# EAGLE board BMS-HVver3 (EAGLE 6.6.0), part 1 of 2 (continued)
## Placement (x,y rotation side) (continued)
SJ14  [PAD-JUMPER-3-NO_YES_SILK]  45.06,76.7 0 top
SJ15  [PAD-JUMPER-2-NO_YES_SILK]  44.91,71.75 90 top
TX1  PE-68386NLT  [PE-68386NLT]  145.92,80.16 0 top
TX2  PE-68386NLT  [PE-68386NLT]  145.92,70.38 0 top
TX3  PE-68386NLT  [PE-68386NLT]  145.92,91.46 0 top
U1  LTC6804-2  [SSOP-48]  127.61,71.27 270 top
U2  LTC6804-2  [SSOP-48]  82.04,71.14 270 top
U3  LTC6804-2  [SSOP-48]  37.08,71.27 270 top
U$1  POGOPIN  [POGOPIN]  125.65,11.12 0 top
U$2  POGOPIN  [POGOPIN]  116.08,18.64 0 top
U$3  POGOPIN  [POGOPIN]  126.9,27.37 0 top
U$4  POGOPIN  [POGOPIN]  116.08,36.14 0 top
U$5  POGOPIN  [POGOPIN]  126.92,44.9 0 top
U$6  POGOPIN  [POGOPIN]  116.08,53.64 0 top
U$7  POGOPIN  [POGOPIN]  126.92,62.38 0 top
U$8  POGOPIN  [POGOPIN]  116.08,71.14 0 top
U$9  POGOPIN  [POGOPIN]  126.92,79.88 0 top
U$10  POGOPIN  [POGOPIN]  116.05,88.61 0 top
U$11  POGOPIN  [POGOPIN]  126.92,97.38 0 top
U$12  POGOPIN  [POGOPIN]  116.08,106.11 0 top
U$13  POGOPIN  [POGOPIN]  125.68,113.63 0 top
U$14  POGOPIN  [POGOPIN]  34.87,11.12 0 top
U$15  POGOPIN  [POGOPIN]  25.27,18.61 0 top
U$16  POGOPIN  [POGOPIN]  36.12,27.37 0 top
U$17  POGOPIN  [POGOPIN]  25.27,36.14 0 top
U$18  POGOPIN  [POGOPIN]  36.12,44.87 0 top
U$19  POGOPIN  [POGOPIN]  25.27,53.64 0 top
U$20  POGOPIN  [POGOPIN]  36.12,62.38 0 top
U$21  POGOPIN  [POGOPIN]  25.27,71.14 0 top
U$22  POGOPIN  [POGOPIN]  36.12,79.88 0 top
U$23  POGOPIN  [POGOPIN]  25.27,88.61 0 top
U$24  POGOPIN  [POGOPIN]  36.12,97.38 0 top
U$25  POGOPIN  [POGOPIN]  25.27,106.11 0 top
U$26  POGOPIN  [POGOPIN]  34.87,113.63 0 top
U$27  LOGO16-2-L  [2016-2-LOGO-L]  49.5,15.08 90 top
U$28  NSV1C201MZ4T1G  [SOT223]  41.05,90.65 0 top
U$29  NSV1C201MZ4T1G  [SOT223]  88.01,89.68 0 top
U$30  NSV1C201MZ4T1G  [SOT223]  134.62,89.68 0 top
U$40  POGOPIN  [POGOPIN]  80.26,11.12 0 top
U$41  POGOPIN  [POGOPIN]  70.66,18.61 0 top
U$42  POGOPIN  [POGOPIN]  81.51,27.35 0 top
U$43  POGOPIN  [POGOPIN]  70.66,36.11 0 top
U$44  POGOPIN  [POGOPIN]  81.51,44.85 0 top
U$45  POGOPIN  [POGOPIN]  70.66,53.64 0 top
U$46  POGOPIN  [POGOPIN]  81.51,62.38 0 top
U$47  POGOPIN  [POGOPIN]  70.66,71.11 0 top
U$48  POGOPIN  [POGOPIN]  81.51,79.88 0 top
U$49  POGOPIN  [POGOPIN]  70.66,88.64 0 top
U$50  POGOPIN  [POGOPIN]  81.51,97.38 0 top
U$51  POGOPIN  [POGOPIN]  70.66,106.11 0 top
U$52  POGOPIN  [POGOPIN]  80.26,113.61 0 top

## Tracks (layer width: path | path; a pad name or v marks a point on that pad's centre or on a via)
A0
  Top 0.178: U2.45 90.36,75.39 90.68,75.71 90.68,76.78 SJ9.2
A1
  Top 0.178: U2.46 87.55,75.89 87.76,76.09 87.76,77.87 88.01,78.12 90.55,78.12 90.68,78.25 90.68,79.32 SJ8.2
A2
  Top 0.178: U2.47 87.04,76.39 87.25,76.6 87.25,80.16 87.76,80.66 90.42,80.66 90.75,80.99 SJ7.2
A3
  Top 0.178: U2.48 86.52,76.89 86.74,77.11 86.74,82.95 87.25,83.46 90.42,83.46 90.68,83.71 90.68,84.58 SJ6.2
A4
  Top 0.178: U1.45 133.64,75.52 134.21,76.09 134.21,78.5 134.65,78.94 136.6,78.94 136.78,78.76 136.78,77.74 SJ4.2
A5
  Top 0.178: U1.46 133.43,76.02 133.73,76.32 133.73,81.07 134.21,81.55 136.53,81.55 136.73,81.35 136.73,80.28 SJ3.2
A6
  Top 0.178: U1.47 133.11,76.52 133.3,76.7 133.3,83.38 133.91,83.99 136.45,83.99 136.75,83.69 SJ2.2
A7
  Top 0.178: U1.48 132.55,77.02 132.79,77.26 132.79,85.01 134.42,86.63 136.5,86.63 136.73,86.4 136.73,85.36 SJ1.2
A8
  Top 0.178: U3.45 42.35,75.52 42.62,75.79 42.62,77.69 42.95,78.02 44.96,78.02 45.06,77.92 SJ14.2
A9
  Top 0.178: U3.46 41.86,76.02 42.14,76.29 42.14,80.16 42.7,80.71 44.86,80.71 45.06,80.51 SJ13.2
A10
  Top 0.178: U3.47 41.39,76.52 41.63,76.75 41.63,83.08 42.11,83.56 44.83,83.56 45.06,83.33 SJ12.2
A11
  Top 0.178: U3.48 41.01,77.02 41.05,77.06 41.05,85.79 41.66,86.4 44.81,86.4 45.03,86.17 45.03,84.88 SJ11.2
C0  (via drill 0.3)
  Top 0.178: U2.26 86.4,65.89 86.61,65.68 86.61,64.41 86.36,64.15 78.74,64.15 78.36,63.77 78.36,16.1 | 78.36,16.1 78.36,16.02 78.99,15.38 80.43,15.38 | 80.43,15.38 R110.2 | 80.43,15.38 80.43,16.91 C57.1 | v77.57,15.72 77.57,15.87 77.8,16.1 78.36,16.1
  Bottom 0.178: C55.2 77.94,16.08 v77.57,15.72
C1  (via drill 0.3)
  Top 0.178: U2.24 77.94,65.39 77.6,65.04 77.6,21.1 | 77.6,21.1 77.6,19.07 74.68,16.15 R107.2 | v75.95,21.1 77.6,21.1
  Bottom 0.178: C53.2 75.69,21.35 v75.95,21.1 76.24,20.81 C55.1
C2  (via drill 0.3)
  Top 0.178: U2.22 77.17,66.39 76.71,65.93 76.71,29.99 | 76.71,29.99 76.71,29.74 74.8,27.83 73.53,27.83 | 73.53,27.83 69.48,27.83 R104.2 | v75.69,29.99 76.71,29.99 | v73.53,26.18 73.53,27.83
  Bottom 0.178: C51.2 75.31,30.37 v75.69,29.99 | C53.1 75.69,25.93 75.44,26.18 v73.53,26.18
C3  (via drill 0.3)
  Top 0.178: U2.20 76.26,67.39 75.95,67.07 75.95,38.25 | 75.95,38.25 75.95,34.94 75.5,34.5 | 75.5,34.5 74.8,33.8 R101.2 | v74.93,38.25 75.95,38.25 | v74.93,35.07 75.5,34.5
  Bottom 0.178: C49.2 74.17,38.37 74.3,38.25 v74.93,38.25 | C51.1 75.31,34.69 v74.93,35.07
C4  (via drill 0.3)
  Top 0.178: U2.18 75.61,68.39 75.18,67.96 75.18,47.77 | 75.18,47.77 75.18,46.75 73.15,44.72 | 73.15,44.72 R98.2 | v74.17,47.77 75.18,47.77 | v73.28,43.71 73.28,44.59 73.15,44.72
  Bottom 0.178: C47.2 73.79,48.15 v74.17,47.77 | C49.1 74.17,43.45 73.91,43.71 v73.28,43.71
C5  (via drill 0.3)
  Top 0.178: U2.16 74.83,69.39 74.42,68.98 74.42,59.07 | 74.42,59.07 74.42,52.6 73.79,51.96 | R92.2 69.33,51.45 73.28,51.45 73.79,51.96 | v73.15,59.2 74.3,59.2 74.42,59.07 | 73.79,51.96 73.79,52.34 v73.41,52.72
  Bottom 0.178: C43.2 72.39,59.58 72.77,59.2 v73.15,59.2 | v73.41,52.72 73.41,52.6 73.91,52.09 73.91,51.29 C47.1
C6  (via drill 0.3)
  Top 0.178: U2.14 74.05,70.39 73.66,70 73.66,66.44 | 73.66,66.44 73.66,63.65 73.15,63.14 72.26,63.14 | 69.18,63.65 R95.2 69.43,63.14 72.26,63.14 | v72.14,63.65 72.14,63.26 72.26,63.14 | 73.66,66.44 73.53,66.31 v73.03,66.31
  Bottom 0.178: C43.1 72.39,63.39 v72.14,63.65 | v73.03,66.31 72.64,66.31 72.39,66.57 72.39,67.7 C45.2
C7  (via drill 0.3)
  Top 0.178: U2.12 73.28,71.39 73.15,71.27 | 73.15,71.27 72.9,71.01 72.9,69.87 71.88,68.98 69.18,68.98 R89.2 | v71.88,74.57 71.88,72.53 73.15,71.27
  Bottom 0.178: C41.2 v71.88,74.57 72.64,73.81 C45.1
C8  (via drill 0.3)
  Top 0.178: U2.10 73.68,72.39 73.41,72.66 73.41,78.89 73.34,78.95 | 73.34,78.95 72.01,80.28 | 72.01,80.28 69.61,80.28 R86.2 | v72.26,81.68 72.26,80.66 72.01,80.41 72.01,80.28 | v71.88,78.89 73.28,78.89 73.34,78.95
  Bottom 0.178: C39.2 v72.26,81.68 | C41.1 71.88,77.36 72.01,77.23 72.01,78.76 v71.88,78.89
C9  (via drill 0.3)
  Top 0.178: U2.8 74.59,73.39 74.3,73.68 74.3,84.98 73.28,86 73.15,86 | 73.15,86 72.39,86 | 72.39,86 R83.2 | v73.66,91.33 73.66,86.5 73.15,86 | v72.39,87.14 72.39,86
  Bottom 0.178: C37.2 73.53,91.46 v73.66,91.33 | C39.1 72.26,87.01 v72.39,87.14
C10  (via drill 0.3)
  Top 0.178: U2.6 75.24,74.39 75.06,74.57 75.06,96.28 73.91,97.43 73.79,97.43 | 73.79,97.43 73.66,97.43 | 73.66,97.43 69.56,97.43 R77.2 | v73.66,96.28 73.66,97.43 | v73.91,99.84 73.91,97.55 73.79,97.43
  Bottom 0.178: C37.1 73.53,96.16 v73.66,96.28
  Bottom 0.254: C34.2 v73.91,99.84
C11  (via drill 0.3)
  Top 0.178: U2.4 76.14,75.39 75.82,75.71 75.82,102.25 73.91,104.16 | 73.91,104.16 69.56,104.16 R78.2 | v74.04,105.43 74.04,104.28 73.91,104.16
  Bottom 0.178: C34.1 73.91,105.3 v74.04,105.43 74.17,105.56 74.17,107.46 74.3,107.59 C33.2
C12  (via drill 0.3)
  Top 0.178: U2.2 76.79,76.39 76.58,76.6 76.58,105.43 79.12,107.97 79.12,108.35 | 79.12,108.35 79.12,111.14 78.87,111.4 R76.2 | v79.25,108.22 79.12,108.35
  Bottom 0.178: C33.1 78.61,107.59 v79.25,108.22
C13  (via drill 0.3)
  Top 0.178: R4.2 124.66,110.97 125.55,110.08 125.55,107.26 | 125.55,107.26 125.55,106.34 123.7,104.49 123.7,78.28 123.04,77.61 123.04,76.65 123.17,76.52 U1.2 | v124.51,107.21 125.5,107.21 125.55,107.26
  Bottom 0.178: C3.1 124.28,106.11 124.51,106.34 v124.51,107.21
C14  (via drill 0.3)
  Top 0.178: R6.2 121.54,100.68 | 121.54,100.68 122.3,100.68 122.94,100.04 122.94,78.66 122.28,78 122.28,76.07 122.81,75.53 124.17,75.53 U1.4 | v121.51,103.24 121.51,100.7 121.54,100.68
  Bottom 0.178: C4.1 121.54,103.22 v121.51,103.24 121.53,103.26 C3.2
C15  (via drill 0.3)
  Top 0.178: R11.2 119.18,86.12 | 119.18,86.12 120.5,86.12 121.39,85.23 121.39,79.32 120.68,78.61 120.68,75.41 122.58,73.5 124.17,73.5 U1.8 | v119.13,86.99 119.13,86.17 119.18,86.12
  Bottom 0.178: C9.1 119.02,86.89 v119.13,86.99 119.1,87.01 C7.2
C16  (via drill 0.3)
  Top 0.178: U1.12 119.43,71.52 118.91,71 | 118.91,71 116.74,68.83 115.56,68.83 R17.2 | v118.8,71.82 118.8,71.11 118.91,71
  Bottom 0.178: C15.1 118.82,71.8 v118.8,71.82 118.75,71.88 C11.2
C17  (via drill 0.3)
  Top 0.178: U1.14 120.13,70.52 117.07,67.45 117.07,65.17 | 117.07,65.17 117.07,62.68 116.74,62.35 115.81,62.35 R23.2 | v116.21,65.14 117.04,65.14 117.07,65.17
  Top 0.254: v116.76,61.31 115.95,61.31 115.85,61.41 115.85,62.31 R23.2
  Bottom 0.178: C15.2 118.82,66.06 118.34,65.58 116.64,65.58 v116.21,65.14
  Bottom 0.254: C13.1 116.38,60.93 v116.76,61.31
C18  (via drill 0.3)
  Top 0.178: U1.16 120.5,69.52 118.03,67.05 118.03,56.05 118.03,52.06 117.72,51.74 117.32,51.35 115.21,51.35 115.11,51.45 115.11,51.25 115.14,51.22 115.12,51.22 R20.2
  Top 0.254: v116.71,56.08 118.01,56.08 118.03,56.05 | v117.35,52.24 117.35,52.11 117.72,51.74
  Bottom 0.254: C13.2 116.38,56.41 v116.71,56.08 | C17.1 117.7,51.88 v117.35,52.24
C19  (via drill 0.3)
  Top 0.178: U1.20 121.29,67.52 119.94,66.16 119.94,37.66 119.94,35.83 119.3,35.2 | v119.24,35.13 118.03,33.93 R29.2
  Top 0.254: v119.05,37.59 119.86,37.59 119.94,37.66 | v119.24,35.13 119.3,35.2
  Bottom 0.254: C19.2 118.92,37.71 v119.05,37.59 | C23.1 119.53,34.84 v119.24,35.13
C20  (via drill 0.3)
  Top 0.178: U1.22 121.69,66.52 120.9,65.73 120.9,30.35 120.42,29.86 | v120.16,29.6 117.88,27.32 117.75,27.32 R32.2
  Top 0.254: v120.16,29.6 120.42,29.86 | v118.8,26.31 118.77,26.31 117.75,27.32
  Bottom 0.254: C23.2 119.53,30.22 v120.16,29.6 | C25.1 120.34,25.77 120.04,26.08 119.02,26.08 v118.8,26.31
C21  (via drill 0.3)
  Top 0.178: U1.24 122.16,65.52 121.9,65.25 121.9,20.57 121.9,17.14 121.27,16.52 | v121.32,16.62 118.72,13.96 116.32,13.96 R35.2
  Top 0.254: v120.17,20.62 121.84,20.62 121.9,20.57 | v121.32,16.62 121.27,16.52
  Bottom 0.254: C25.2 120.34,20.8 v120.17,20.62 | C27.1 121.58,16.31 v121.32,16.62
C22  (via drill 0.3)
  Top 0.178: R5.2 v121.34,95.52 121.62,95.52 122.17,94.96 122.17,78.99 121.49,78.3 121.49,75.69 122.66,74.52 U1.6
  Top 0.254: v121.28,98.44 121.28,95.57 v121.34,95.52
  Bottom 0.178: C7.1 119.1,95.14 119.48,95.52 v121.34,95.52
  Bottom 0.254: C4.2 121.54,98.7 v121.28,98.44
C23  (via drill 0.3)
  Top 0.178: R38.2 123.41,14.89 122.83,15.46 122.83,63.72 123.34,64.23 131.72,64.23 132.33,64.84 132.33,65.88 132.21,66.01 U1.26
  Top 0.254: v124.71,16.17 125.15,16.17 125.55,15.77 125.55,14.94 R38.2
  Bottom 0.254: C29.1 123.28,18 C27.2 124.48,15.38 124.71,15.61 v124.71,16.17
C24  (via drill 0.3)
  Top 0.178: U1.18 120.87,68.52 118.97,66.62 118.97,46.58 118.64,46.25 117.3,44.9 116.79,44.9 115.2,44.9 R26.2
  Top 0.254: v118.03,46.93 118.03,46.86 118.64,46.25 | v116.81,43.76 116.81,44.87 116.79,44.9
  Bottom 0.254: C17.2 117.7,47.26 v118.03,46.93 | C19.1 118.92,43.22 118.59,43.55 117.02,43.55 v116.81,43.76
C25  (via drill 0.3)
  Top 0.178: R14.2 118.44,78.89 | 118.44,78.89 119.05,78.89 | 119.05,78.89 119.89,78.05 119.89,75.1 122.48,72.51 U1.10 | v118.42,77.87 118.42,78.86 118.44,78.89 | v119,81.27 119,78.94 119.05,78.89
  Bottom 0.178: C11.1 118.75,77.54 v118.42,77.87 | C9.2 119.02,81.5 v119,81.27
C26  (via drill 0.3)
  Top 0.178: U3.2 31.66,76.52 31.3,76.87 31.3,101.4 31.93,102.02 32.82,102.02 33.53,102.74 33.53,102.91 | 33.53,102.91 33.53,105.06 R151.2 | v33.88,102.56 33.53,102.91
  Bottom 0.178: C65.1 33.73,102.71 v33.88,102.56
C27  (via drill 0.3)
  Top 0.178: U3.4 30.7,75.52 30.42,75.89 30.42,100.69 v29.97,101.13 29.71,101.4 29.62,101.49 23.79,101.49 R153.2
  Bottom 0.178: C65.2 29.77,102.71 29.62,102.56 29.62,101.49 v29.97,101.13 29.79,100.96 29.79,99.89 29.59,99.69 C66.1
C28  (via drill 0.3)
  Top 0.178: U3.8 28.88,73.52 28.64,73.75 28.64,85.93 28.19,86.38 27.48,86.38 | 27.48,86.38 24.32,86.38 R158.2 | v27.66,87.62 27.66,86.56 27.48,86.38
  Bottom 0.178: C71.1 27.51,87.47 v27.66,87.62 27.69,87.65 C69.2
C29  (via drill 0.3)
  Top 0.178: U3.12 27.82,71.52 27.57,71.27 27.57,69.84 | 27.57,69.84 27.57,69.49 26.89,68.8 R164.2 | v26.77,69.84 27.57,69.84
  Bottom 0.178: C77.1 26.62,69.69 v26.77,69.84 27.51,70.58 C73.2
C30  (via drill 0.3)
  Top 0.178: U3.14 28.78,70.52 28.46,70.2 28.46,65.75 27.22,64.51 26.77,64.51 | R170.2 26.77,64.51 | v26.77,65.4 26.77,64.51 | v26.65,62.22 26.65,64.38 26.77,64.51
  Bottom 0.178: C77.2 26.62,65.55 v26.77,65.4 | C75.1 v26.65,62.22
C31  (via drill 0.3)
  Top 0.178: U3.16 29.73,69.52 29.35,69.13 29.35,57.75 29.26,57.66 | R167.2 28.35,51.5 29.26,52.42 29.26,53.31 | 29.26,53.31 29.26,57.66 | v28.19,53.31 29.26,53.31 | v26.92,57.83 29.1,57.83 29.26,57.66
  Bottom 0.178: C79.1 28.4,53.1 v28.19,53.31 | C75.2 26.65,58.11 v26.92,57.83
C32  (via drill 0.3)
  Top 0.178: U3.20 31.2,67.52 31.04,67.35 31.04,36.06 30.68,35.7 | R176.2 28.88,33.9 30.68,35.7 | v29.97,36.24 30.15,36.24 30.68,35.7
  Bottom 0.178: C83.1 30.25,35.96 v29.97,36.24 29.46,36.75 C81.2
C33  (via drill 0.3)
  Top 0.178: U3.22 31.98,66.52 31.75,66.29 31.75,30.9 | 31.75,30.9 31.75,29.66 29.52,27.42 v25.53,27.42 23.93,27.42 R179.2 | v30.51,31.08 31.57,31.08 31.75,30.9
  Bottom 0.178: C83.2 30.25,31.34 v30.51,31.08 | C85.1 25.85,27.11 v25.53,27.42
C34  (via drill 0.3)
  Top 0.178: U3.24 32.76,65.52 32.46,65.22 32.46,28.06 29.08,24.68 29.08,23.97 | R182.2 27.48,14.19 29.08,15.79 29.08,17.57 | 29.08,17.57 29.08,23.97 | v27.84,23.97 29.08,23.97 | v28.19,17.39 28.91,17.39 29.08,17.57
  Bottom 0.178: C85.2 27.55,24.26 v27.84,23.97 | C87.1 28.22,17.42 v28.19,17.39
C35  (via drill 0.3)
  Top 0.178: U3.6 29.83,74.52 29.53,74.82 29.53,95.18 29.08,95.62 v27.48,95.62 26.59,95.62 26.24,95.98 26.24,97.06 R152.2
  Top 0.254: R152.2 26.1,97.97 25.88,98.19 24.84,98.19 v24.61,98.42
  Bottom 0.178: C69.1 27.69,95.42 v27.48,95.62
  Bottom 0.254: v24.61,98.42 24.61,99.41 24.94,99.74 27.01,99.74 C66.2
C36  (via drill 0.5)
  Top 0.178: U3.26 40.56,66.01 41.5,66.01 41.71,65.77 41.71,65.22 41.53,65.04 38.86,65.04 38.33,64.51 33.35,64.51 33.17,64.33 33.17,17.39 v33.35,17.21 34.77,17.21 34.98,17.01 R185.2
  Bottom 0.178: C87.2 33.15,17.42 v33.35,17.21 33.41,17.15 C89.1
C37  (via drill 0.3)
  Top 0.178: U3.18 30.51,68.52 30.24,68.24 30.24,51.35 30.15,51.26 30.15,48.51 | R173.2 29.26,44.52 | 29.26,44.52 29.9,44.52 30.15,44.77 30.15,48.51 | v28.73,48.51 30.15,48.51 | v29.26,43.53 29.26,44.52
  Bottom 0.178: C79.2 28.4,48.84 v28.73,48.51 | C81.1 29.46,43.33 v29.26,43.53
C38  (via drill 0.3)
  Top 0.178: U3.10 28.01,72.52 27.83,72.7 27.83,78.56 | 27.83,78.56 27.83,79.28 27.3,79.8 | 27.3,79.8 23.99,79.8 R161.2 | v26.95,78.56 27.83,78.56 | v27.3,81.58 27.3,79.8
  Bottom 0.178: C73.1 27.51,78 v26.95,78.56 | C71.2 27.51,81.78 v27.3,81.58
DRIVE  (via drill 0.3)
  Top 0.178: U$29.P$1 86.87,89.68 86.49,89.3 86.49,84.65 v86.56,84.58 | v87,72.05 86.84,71.9 85.48,71.9 U2.38
  Bottom 0.178: v86.56,84.58 86.56,72.48 v87,72.05
DRIVE1  (via drill 0.3)
  Top 0.178: U$30.P$1 134.62,88.08 v132,85.46 | v132.51,72.31 132.16,72 131.04,72 U1.38
  Bottom 0.178: v132,85.46 132,72.81 v132.51,72.31
DRIVE2  (via drill 0.3, 0.5)
  Top 0.178: U3.38 41.85,72.02 v42.06,72.23 | v40.95,87.24 41,90.59 U$28.P$1
  Bottom 0.178: v40.95,87.24 40.97,85.62 41.02,74.44 42.06,73.22 v42.06,72.23
GND  (via drill 0.3, 0.5, 0.6)
  Top 0.178: v38.86,67.07 39.04,68.24 39.4,68.6 40.42,68.6 U3.31
  other vias: 41.94,45.5 22.5,107.89 28.19,116.43 9.88,100.25 15.04,90.65 9.88,92.78 4.72,94.38 13.61,83.18 13.97,74.47 10.06,77.67 4.19,78.73 4.01,86.56 4.01,101.31 25.17,111.98 37.08,101.31 11.84,39.26 4.01,41.22 4.19,49.22 4.19,56.33 4.19,63.62 4.01,71.09 11.13,69.84 14.5,59 10.24,62.91 27.3,46.91 14.5,54.02 14.5,45.48 13.61,31.08 24.46,39.79 5.79,33.75 4.19,26.28 14.68,21.13 47.32,74.97 46.53,69.49 48.11,52.29
  pour Top (rank 4): -2.54,130.95 49.53,130.95 49.53,-6.2 -2.54,-6.2
  pour Bottom: -2.54,129.69 49.53,129.69 49.53,-7.47 -2.54,-7.47
GNDA  (via drill 0.5)
  other vias: 90.02,61.89 80.29,35.53 83.31,41.75 74.24,18.99 93.32,78.28 78,81.3 94.62,73.84 65.99,6.93 77.67,14.17 75.64,9.21 76.4,7.94 62.31,12.9 62.56,17.59 56.08,18.99 56.85,27.5 72.47,30.04 73.36,37.28 54.56,41.22 54.94,34.87 72.47,47.31 62.56,38.68 54.69,49.85 61.16,53.79 67.77,59 55.07,57.6 55.19,65.22 65.86,74.62 63.45,70.3 54.69,70.81 54.94,79.7 63.58,82.49 60.78,75.89 56.59,86.17 72.47,91.76 61.54,91.25 56.72,93.92 71.58,99.89 56.59,102.68
  pour Top (rank 6): 52.07,130.95 52.07,-6.2 95.25,-6.2 95.25,130.95
  pour Bottom (rank 6): 52.07,129.69 52.07,-7.47 95.25,-7.47 95.25,129.69
GNDI  (via drill 0.5)
  Top 0.178: U1.31 U1.30
  other vias: 140.89,76.09 127.05,86.66 115.98,91.41 109.37,81.88 110.24,74.54 109.07,69.72 110.92,64.81 111.71,57.8 108.84,53.54 113.84,47.06 114.33,40.28 108.76,38.12 115.09,29.66 115.54,22.45 103.07,19.27 127.74,111.09 99.14,111.52 102.29,106.72 119.43,104.44 121.46,122.27 100.23,122.04
  pour Top (rank 4): 97.79,129.69 97.79,-3.67 137.16,-3.67 137.16,26.81 142.24,31.89 142.24,57.3 140.97,58.56 140.97,130.19
  pour Bottom: 97.79,-2.39 97.79,128.42 140.97,129.05 140.97,58.56 142.24,57.3 142.24,31.89 137.16,26.81 137.16,-3.67
GPIO1
  Top 0.178: U2.27 86.67,66.39 87.12,65.93 87.12,54.25 | R139.4 87.61,53.76 87.12,54.25 | NTC8.2 84.2,20.06 85.88,21.73 85.88,53.61 86.51,54.25 87.12,54.25
GPIO2  (via drill 0.3)
  Top 0.178: U2.28 86.8,66.89 87.5,66.19 87.5,55.26 88.16,54.61 v88.24,54.61 88.39,54.61 R139.3
  Bottom 0.178: NTC7.2 84.02,55.44 84.25,55.67 87.18,55.67 v88.24,54.61
GPIO3  (via drill 0.3)
  Top 0.178: R139.2 88.63,55.41 87.88,56.15 87.88,66.57 87.06,67.39 U2.29 84.15,67.38 v84.07,67.3
  Bottom 0.178: NTC6.2 85.16,107.45 85.7,106.9 85.7,67.62 U2.29 84.16,67.39 v84.07,67.3
GPIO4  (via drill 0.3)
  Top 0.178: R139.1 88.92,56.26 88.39,56.79 88.39,66.95 86.45,68.89 U2.32 v83.8,68.88
  Bottom 0.178: NTC5.2 84.95,89.92 85.27,89.6 85.27,69.26 84.91,68.9 83.82,68.9 v83.8,68.88
GPIO5  (via drill 0.3)
  Top 0.178: U2.33 86.59,69.39 88.9,67.07 88.9,59.58 89.34,59.14 | R138.2 93.38,65.04 93.47,65.04 93.6,65.17 94.49,65.17 94.87,64.79 94.87,59.96 94.36,59.45 93.47,59.45 93.09,59.07 89.41,59.07 89.34,59.14 | D38.C 85.84,57.28 v85.65,57.09 | v89.26,57.45 89.26,59.05 89.34,59.14
  Bottom 0.178: v85.65,57.09 88.9,57.09 v89.26,57.45
GPIO6  (via drill 0.3)
  Top 0.178: R67.2 135.99,50.23 135.13,50.23 134.47,50.89 134.47,67.23 134.18,67.52 U1.29 129.72,67.51 v129.51,67.3
  Bottom 0.178: NTC10.2 131.05,89.94 130.73,89.63 130.73,67.89 130.35,67.51 129.72,67.51 v129.51,67.3
GPIO7  (via drill 0.3)
  Top 0.178: R67.1 135.99,51.12 135.25,51.12 134.87,51.5 134.87,68.6 134.46,69.02 U1.32 129.6,69.02 v129.26,68.67
  Bottom 0.178: NTC9.2 133.42,107.47 133.78,107.1 133.78,103.88 131.06,101.16 131.06,101.13 130.76,100.83 130.76,91.33 130.35,90.92 130.35,69.74 129.29,68.67 v129.26,68.67
GPIO8  (via drill 0.3)
  Top 0.178: U1.27 133.45,66.52 133.68,66.29 133.68,49.37 134.37,48.68 134.42,48.63 | 134.42,48.63 134.47,48.58 135.99,48.58 R67.4 | v134.42,47.95 134.42,48.63
  Bottom 0.178: NTC12.2 133.59,19.48 134.37,20.26 134.37,47.9 v134.42,47.95
GPIO9  (via drill 0.3)
  Top 0.178: U1.28 133.84,67.02 134.09,66.77 134.09,50.11 134.58,49.61 v134.62,49.57 134.75,49.45 R67.3
  Bottom 0.178: NTC11.2 131.72,50.21 132.16,49.78 134.42,49.78 v134.62,49.57
GPIO10
  Top 0.178: U1.33 137.11,69.52 137.54,69.08 137.54,62.6 138.05,62.1 139.36,62.1 D39.C 139.45,62.01 R66.2
GPIO11  (via drill 0.3)
  Top 0.178: R214.2 41.93,49.19 41.96,49.22 38.08,49.22 37.64,49.65 37.64,59.63 39.75,61.74 44.2,61.74 45.03,62.58 45.03,66.46 43.98,67.52 41.91,67.52 | U3.29 41.91,67.52 | v41.89,67.84 41.89,67.54 41.91,67.52
  Bottom 0.178: NTC2.2 37.45,89.87 37.14,89.55 37.14,82.87 37.54,82.47 38.94,82.47 39.37,82.03 39.37,69.06 39.62,68.8 41.35,68.8 41.66,68.5 41.66,68.06 v41.89,67.84
GPIO12  (via drill 0.3)
  Top 0.178: R214.1 40.58,50.04 40.34,50.28 40.34,60.47 41.07,61.21 44.35,61.21 45.57,62.43 45.57,66.74 43.3,69.02 43.05,69.02 | U3.32 43.05,69.02 | v42.95,68.42 42.95,68.91 43.05,69.02
  Bottom 0.178: NTC1.2 38.81,92.58 40.16,91.23 40.16,69.82 40.56,69.41 42.43,69.41 42.82,69.02 42.82,68.55 v42.95,68.42
GPIO13  (via drill 0.3)
  Top 0.178: R214.4 v39.93,47.54 37.72,47.54 36.68,48.58 36.68,59.99 39.57,62.88 43.71,62.88 43.99,63.16 43.99,65.91 43.37,66.5 43.31,66.52 U3.27
  Bottom 0.178: NTC4.2 40.6,17.74 40.87,18 40.87,46.6 v39.93,47.54
GPIO14  (via drill 0.3)
  Top 0.178: R214.3 41.84,48.35 v38.18,48.35 37.92,48.35 37.24,49.04 37.24,59.91 39.57,62.25 44.02,62.25 44.5,62.73 44.5,66.34 43.82,67.02 U3.28
  Bottom 0.178: NTC3.2 37.48,54.46 37.24,54.22 37.24,49.29 v38.18,48.35
GPIO15  (via drill 0.3)
  Top 0.178: R213.2 44.55,60.55 45.26,61.26 | 45.26,61.26 46.15,62.15 46.15,67.45 44.07,69.54 40.53,69.54 U3.33 | v45.67,60.85 45.26,61.26
  Top 0.305: D37.C 48.62,58.18 v48.69,58.11
  Bottom 0.305: v48.69,58.11 46.2,58.11 45.8,58.51 45.8,60.72 v45.67,60.85
IBIAS  (via drill 0.3)
  Top 0.254: U2.44 84.01,74.89 v83.57,75.33
  Bottom 0.254: v83.57,75.33 82.42,75.33 82.17,75.58 82.17,75.47 R141.2
IBIAS1  (via drill 0.3)
  Top 0.254: U1.44 129.19,75.02 129.03,75.18 129.03,76.32 v128.98,76.37
  Bottom 0.254: v128.98,76.37 127.65,76.37 R69.2
IBIAS2  (via drill 0.3)
  Top 0.178: U3.44 38.92,75.02 v38.63,75.3
  Bottom 0.178: v38.63,75.3 37.33,75.3 R216.2
ICMP  (via drill 0.3)
  Top 0.254: U2.43 84.15,74.39 v83.57,73.81
  Bottom 0.254: v83.57,73.81 82.21,73.81 R141.1 82.17,73.67 82.17,73.55 82.12,73.5 R142.2
ICMP1  (via drill 0.3)
  Top 0.254: U1.43 129.28,74.52 v129.11,74.34
  Bottom 0.254: v129.11,74.34 127.98,74.34 127.67,74.65 | 127.67,74.65 R69.1 | R70.2 127.58,74.57 127.67,74.65
ICMP2  (via drill 0.3)
  Top 0.178: U3.43 39.12,74.52 v38.41,73.53
  Bottom 0.178: v38.41,73.53 37.31,73.53 | 37.31,73.53 37.25,73.53 R216.1 | R217.2 37.21,73.3 37.08,73.42 37.21,73.42 37.31,73.53
IMA  (via drill 0.3)
  Top 0.178: 94.62,75.84 94.62,107.64 v94.97,107.99 | v140.64,77.64 142.52,77.64 TX1.3
  Top 0.254: U2.41 87.09,73.39 87.88,74.19 92.96,74.19 94.62,75.84
  Bottom 0.178: v94.97,107.99 95,107.99 95.5,108.5 103.4,108.5 104.57,109.67 113.41,109.67 114.58,108.5 138.79,108.5 140.26,107.03 140.26,90.09 139.72,89.55 139.72,87.98 140.26,87.44 140.26,78.02 v140.64,77.64
IMA1
  Top 0.178: U1.41 132.43,73.52 133.53,74.62 140.79,74.62 140.97,74.44 140.97,72.92 141.5,72.38 141.5,68.17 141.83,67.84 TX2.3
IMA2  (via drill 0.3)
  Top 0.178: U3.41 48.58,73.52 49.63,74.57 49.63,110.61 51.51,112.49 v52.58,112.49 | v141.1,88.84 142.39,88.84 142.47,88.77 142.42,88.77 142.39,88.79 142.42,88.79 TX3.3
  Bottom 0.178: v52.58,112.49 76.89,112.49 80.01,109.37 102.87,109.37 104.01,110.51 113.77,110.51 114.86,109.42 140.59,109.37 141.55,108.4 141.55,89.3 v141.1,88.84
IPA  (via drill 0.3)
  Top 0.178: 94.11,75.96 94.08,108.37 v93.83,108.63 | v141.28,82.64 142.49,82.64 TX1.1
  Top 0.254: U2.42 86.82,73.89 87.63,74.69 92.84,74.69 94.11,75.96
  Bottom 0.178: v93.83,108.63 94.11,108.91 103.15,108.91 104.32,110.08 113.59,110.08 114.78,108.88 138.99,108.88 140.84,107.03 140.84,89.88 140.36,89.4 140.36,88.11 140.84,87.62 140.84,83.08 v141.28,82.64
IPA1
  Top 0.178: U1.42 132.34,74.02 133.35,75.02 141,75.02 141.35,74.67 141.35,73.27 141.63,72.99 142.47,72.99 TX2.1
IPA2  (via drill 0.3)
  Top 0.178: U3.42 48.14,74.02 48.87,74.75 48.87,111.07 v51.33,113.53 | v142.57,96.06 142.57,94.02 TX3.1
  Bottom 0.178: v51.33,113.53 76.76,113.53 80.21,110.08 102.87,110.08 103.86,111.07 113.92,111.07 114.88,110.1 141.28,110.08 142.34,108.63 142.34,96.21 v142.57,96.06
N$1
  Top 0.254: R7.1 120.52,108.83 Q12.1
N$2
  Top 0.254: R42.2 98.83,99.03 D1.A
  Top 0.813: Q12.3 100.76,110.31 98.68,108.22 98.68,102.27 R42.2
N$3
  Top 0.254: D1.C R9.2
N$4
  Top 0.254: R9.1 104.27,98.95 104.39,99.08 104.39,101.75 104.52,101.87 104.52,102.03 R42.1 | R6.1 114.68,100.68 Q11.2
  Top 0.813: R42.1 114.68,102.13 | 114.68,102.13 115.81,102.13 F26.2 | Q11.2 114.67,102.11 114.68,102.13
N$5
  Top 0.254: R8.1 114.8,98.62 Q11.1
N$6
  Top 0.254: D2.A 98.9,94.81 98.83,94.89
  Top 0.813: R43.2 98.83,94.89 98.83,96.68 99.57,97.43 106.68,97.43 108.97,99.59 112.44,99.59 Q11.3
N$7
  Top 0.254: D2.C 102.36,91.46 102.49,91.59 102.74,91.59 | 103,91.59 102.74,91.59 | 102.74,91.59 102.62,91.71 102.62,91.5 R10.2
N$8  (via drill 0.6)
  Top 0.254: R10.1 104.36,94.34 104.39,94.38 104.39,94.63 R43.1 | R5.1 114.73,95.52 Q10.2
  Top 0.813: v114.68,97.17 114.68,97.05 | 114.68,97.05 114.68,95.6 Q10.2 | R43.1 104.43,95.17 104.78,95.52 107.95,95.52 109.35,96.92 114.55,96.92 114.68,97.05
  Bottom 0.813: F27.2 114.91,97.4 v114.68,97.17
N$9
  Top 0.254: R12.1 114.98,93.36 Q10.1
N$10
  Top 0.254: D3.A 98.9,86.6 98.93,86.63 98.93,86.76 98.68,87.01 98.68,86.76 98.73,86.81 R44.2
  Top 0.813: R44.2 98.83,89.06 99.44,89.68 106.81,89.68 107.7,90.57 107.7,93.24 108.46,94 111.89,94 112.4,94.51 112.44,94.51 Q10.3
N$11
  Top 0.254: D3.C R13.2
N$12
  Top 0.254: R13.1 104.39,83.71 104.52,83.84 104.52,86.71 R44.1 | Q9.2 113.22,86.06 113.41,86.25 113.41,86.16 R11.1
  Top 0.813: F28.2 111.76,88.66 | 111.76,88.66 111.38,88.66 110.74,88.03 105.16,88.03 104.52,87.39 104.52,86.89 104.65,86.76 104.48,86.76 R44.1 | Q9.2 112,88.43 111.76,88.66
N$13
  Top 0.254: Q9.1 112,84.11 112.27,83.84 113.16,83.84 113.41,84.09 113.54,83.97 R15.1
N$14
  Top 0.254: D4.A 98.9,78.98 98.93,79.01 98.68,79.01 98.55,78.89 98.75,78.89 R45.2
  Top 0.813: R45.2 98.83,81.7 99.19,82.06 105.41,82.06 108.46,85.11 Q9.3
N$15
  Top 0.254: D4.C R16.2
N$16  (via drill 0.6)
  Top 0.254: R14.1 112.32,78.89 Q8.2 | R45.1 104.43,76.16 R16.1
  Top 0.813: Q8.2 112.12,80.04 v111.89,80.28 111.38,79.77 104.52,79.77 104.43,79.68 R45.1
  Bottom 0.813: v111.89,80.28 112.01,80.28 112.27,80.03 122.94,80.03 122.94,79.94 F29.2
N$17
  Top 0.254: Q8.1 112.12,76.74 112.27,76.6 R18.1
N$18
  Top 0.254: D5.A 99.03,71.57 98.83,71.77
  Top 0.813: R46.2 98.83,71.77 98.83,73.57 99.57,74.31 106.43,74.31 109.86,77.74 Q8.3
N$19
  Top 0.254: D5.C R19.2
N$20
  Top 0.254: R21.1 112.7,60.22 Q6.1
N$21
  Top 0.254: D6.A 98.9,56.31 98.68,56.53 98.93,56.79 R48.2
  Top 0.813: R48.2 98.83,58.84 99.31,59.33 108.37,59.33 Q6.3
N$22
  Top 0.254: D6.C R22.2
N$23
  Top 0.254: R19.1 104.39,68.6 104.52,68.72 104.52,71.27 104.39,71.39 | R17.1 112.44,68.85 Q7.2
  Top 0.813: 104.43,71.42 104.52,71.52 111.76,71.52 112.14,71.14 F30.2 112.38,70.94 Q7.2 | R46.1 104.43,71.42 | 104.43,71.42 104.39,71.39
N$24
  Top 0.254: R24.1 112.57,66.69 Q7.1
N$25
  Top 0.254: D7.A 98.93,60.98 98.81,61.1 98.81,64.01 R47.2
  Top 0.813: R47.2 98.83,66.33 99.19,66.69 109.14,66.69 Q7.3
N$26
  Top 0.254: D7.C R25.2
N$27  (via drill 0.6)
  Top 0.254: R25.1 104.39,60.98 104.52,61.1 104.52,63.52 | R23.1 112.57,62.38 Q6.2
  Top 0.813: Q6.2 112.65,62.45 v112.65,63.77 112.4,63.52 104.52,63.52 104.43,63.61 R47.1
  Bottom 0.813: F31.2 113.16,62.38 112.65,62.88 v112.65,63.77
N$28
  Top 0.254: R22.1 104.9,53.61 104.9,56.02 104.99,56.12 | R20.1 111.94,51.33 Q5.2
  Top 0.813: F32.2 111.93,53.74 | 111.93,53.74 111.93,55.22 111.12,56.02 105.09,56.02 104.99,56.12 R48.1 | Q5.2 111.87,53.68 111.93,53.74
N$29
  Top 0.254: R27.1 112.06,49.17 Q5.1
N$30
  Top 0.254: D9.A 98.82,49.4 98.81,49.42 98.81,49.36 R49.2
  Top 0.813: R49.2 98.83,51.47 99.31,51.96 108.12,51.96 Q5.3
N$31
  Top 0.254: D9.C 102.76,46.27 R28.2
N$32  (via drill 0.6)
  Top 0.254: R28.1 104.52,46.25 104.65,46.37 104.65,48.44 104.43,48.66 | R26.1 111.89,44.85 111.76,44.72 111.81,44.72 Q4.2
  Top 0.813: Q4.2 111.89,44.8 v111.89,46.37 111.51,46.75 108.08,46.75 106.55,48.28 104.27,48.28 104.43,48.44 104.43,48.66 R49.1
  Bottom 0.813: F33.2 112.4,44.85 111.89,45.36 v111.89,46.37
N$33
  Top 0.254: R30.1 112.14,42.69 112.01,42.82 111.89,42.82 111.76,42.94 111.81,42.94 Q4.1
N$34
  Top 0.254: D10.A 98.9,41.68 R50.2
  Top 0.813: R50.2 98.83,43.73 99.57,44.47 109.14,44.47 Q4.3
N$35
  Top 0.254: D10.C R31.2
N$36
  Top 0.254: R31.1 104.36,41.22 104.36,41.68 R50.1 | Q2.2 113.48,33.99 R29.1
  Top 0.813: Q2.2 112.12,36.3 112.17,36.34 112.17,36.29 112.09,36.21 112.09,36.18 F34.2 112.18,37.93 109.07,41.04 104.53,41.04 104.36,41.22
N$37
  Top 0.254: Q2.1 112.2,32.09 112.4,31.89 R33.1
N$38
  Top 0.254: D11.A 98.81,31.39 98.81,34.18 98.68,34.31 | 98.68,34.31 98.68,34.44 | 98.68,34.31 98.68,34.26 | 98.68,34.18 98.68,34.26 | 98.68,34.26 R51.2
  Top 0.813: Q2.3 110.03,34.85 108.03,36.85 99.19,36.85 98.78,36.44 98.78,34.54 98.68,34.44
N$39
  Top 0.254: D11.C R34.2
N$40  (via drill 0.6)
  Top 0.254: R34.1 104.39,31.39 104.52,31.51 104.52,33.34 104.52,34.31 R51.1 | Q1.2 113.72,27.38 R32.1
  Top 0.813: Q1.2 112.38,28.71 112.32,28.77 | 112.32,28.77 111.43,29.66 109.6,29.66 105.92,33.34 104.52,33.34 | v112.37,28.92 112.37,28.82 112.32,28.77
  Bottom 0.813: F35.2 112.91,27.35 112.38,27.88 v112.38,28.91 v112.37,28.92
N$41
  Top 0.254: Q1.1 113.77,25.48 R36.1
N$42
  Top 0.254: D12.A 98.9,26.47 98.81,26.56 98.81,26.81 98.93,26.94 98.93,26.92 R52.2
  Top 0.813: 98.93,26.94 98.93,28.9 99.47,29.43 107.28,29.43 Q1.3
N$43
  Top 0.254: D12.C 102.68,23.64 R37.2
N$44
  Top 0.254: R39.1 113.33,12.21 Q3.1
N$45
  Top 0.254: D13.C R40.2
N$46
  Top 0.254: R4.1 120.29,110.97 Q12.2
  Top 0.61: 126.49,103.4 126.49,110.38 124.59,112.29 120.4,112.29
  Top 0.813: F25.2 120.96,113.61 120.4,113.17 120.4,112.29 120.4,111.44 Q12.2 | R2.1 127.48,103.33 R3.1 126.43,103.33 126.49,103.4
N$47
  Top 0.254: D13.A 110.91,8.28 R53.2
  Top 0.813: Q3.3 111.17,13.04 110.64,12.52 110.64,8.27 110.77,8.15 110.77,8.3 R53.2 | R53.2 111.05,8.15 111.04,8.15 R53.2
N$48
  Top 0.254: R38.1 125.6,11.17 U$1.1 | R53.1 116.49,5.31 R40.1
  Top 0.813: U$1.1 125.61,11.08 R41.1 121.51,11.07 121.06,10.61 117.91,10.61 116.49,9.19 R53.1
N$49
  Top 0.254: R37.1 104.43,26.05 R52.1 | R35.1 113.33,13.99 Q3.2
  Top 0.813: F36.2 113.67,16.12 113.28,15.74 | 113.28,15.74 113.28,14.45 Q3.2 | 113.28,15.74 113.28,21.96 111.89,23.36 107.7,23.36 106.68,24.38 106.68,25.85 106.4,26.13 104.72,26.13 104.65,26.05 104.43,26.05 | 104.43,26.05 104.19,26.05 104.17,26.03 104.41,26.03 104.43,26.05
N$50
  Top 0.406: R2.2 129.41,101.56 C2.1 129.51,91.86 130.1,91.28 136.37,91.28 136.88,90.77 136.88,89.72 U$30.P$2
N$51
  pour Top: 39.07,110.2 48.74,110.2 48.92,92.93 39.24,92.93
N$52
  Top 0.254: Q13.3 138.04,52.38 137.72,52.06 137.72,51.14 R67.8 R67.7 R67.6 R67.5
N$53
  Top 0.178: R66.1 139.31,57.93 R68.1 139.53,55.98 Q13.1
N$54
  pour Top: 83.31,92.25 93.5,92.25 93.65,109.8 83.46,109.8
N$55
  Top 0.178: R154.1 31.32,108.53 Q25.1
N$56  (via drill 0.6)
  Top 0.61: Q25.3 27.56,109.57 v27.48,109.49 | 1.88,101.31 1.92,101.36 R1.2 1.92,101.54 1.88,101.49 1.88,101.67 2.06,101.85 2.06,98.91 D25.A
  Bottom 0.61: v27.48,109.49 15.04,109.49 14.5,108.96 14.5,103.98 13.08,102.56 2.46,102.56 R1.2